# EAGLE design BMS (EAGLE 6.5.0)
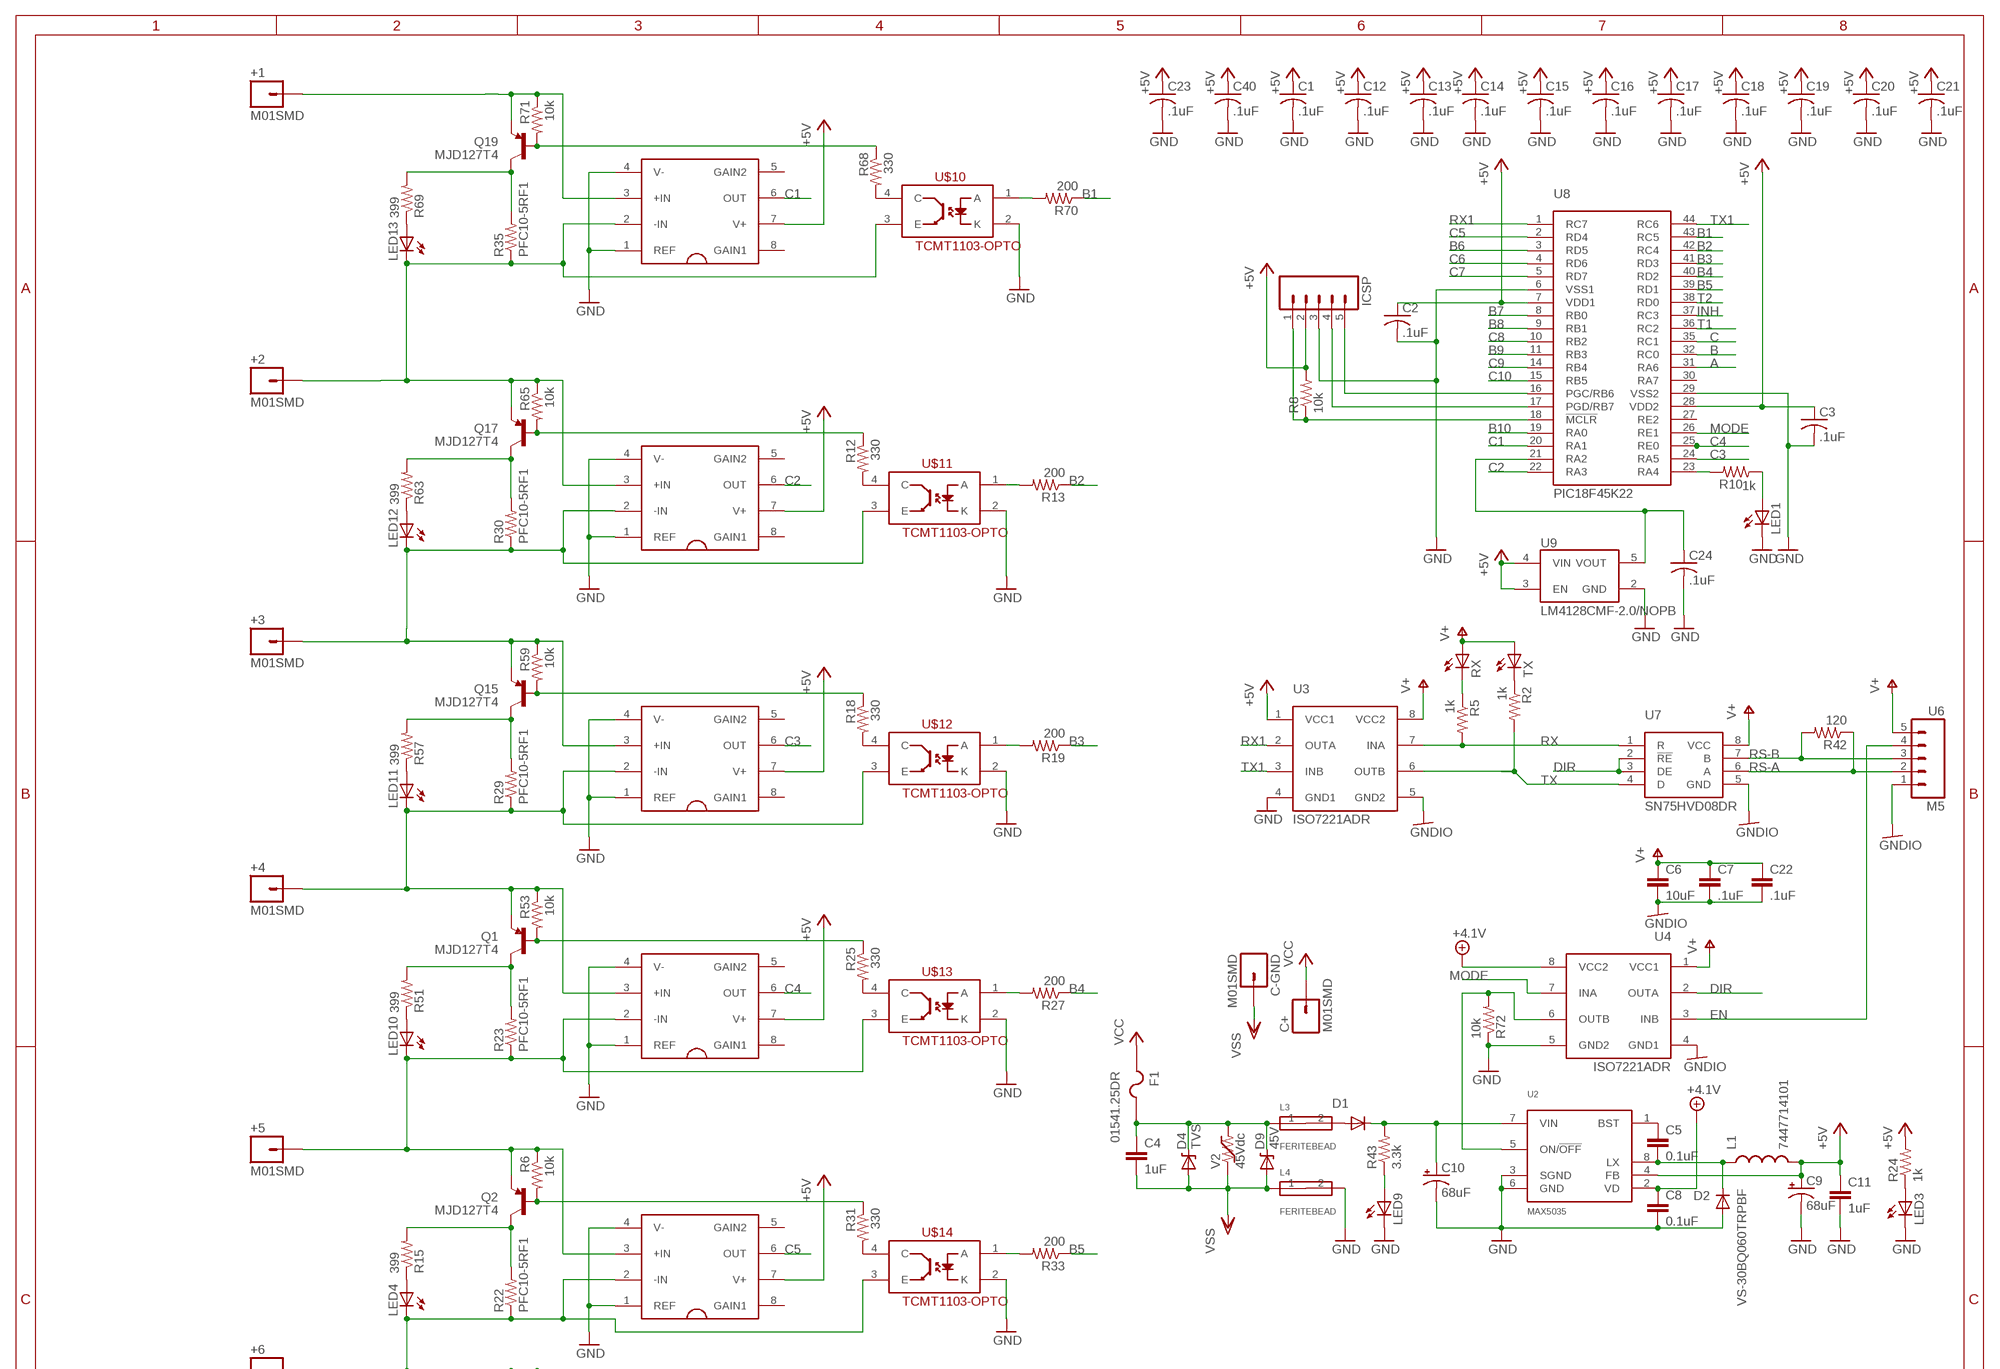
[diagram p0: schematic, sheet 1, part 1 of 2]
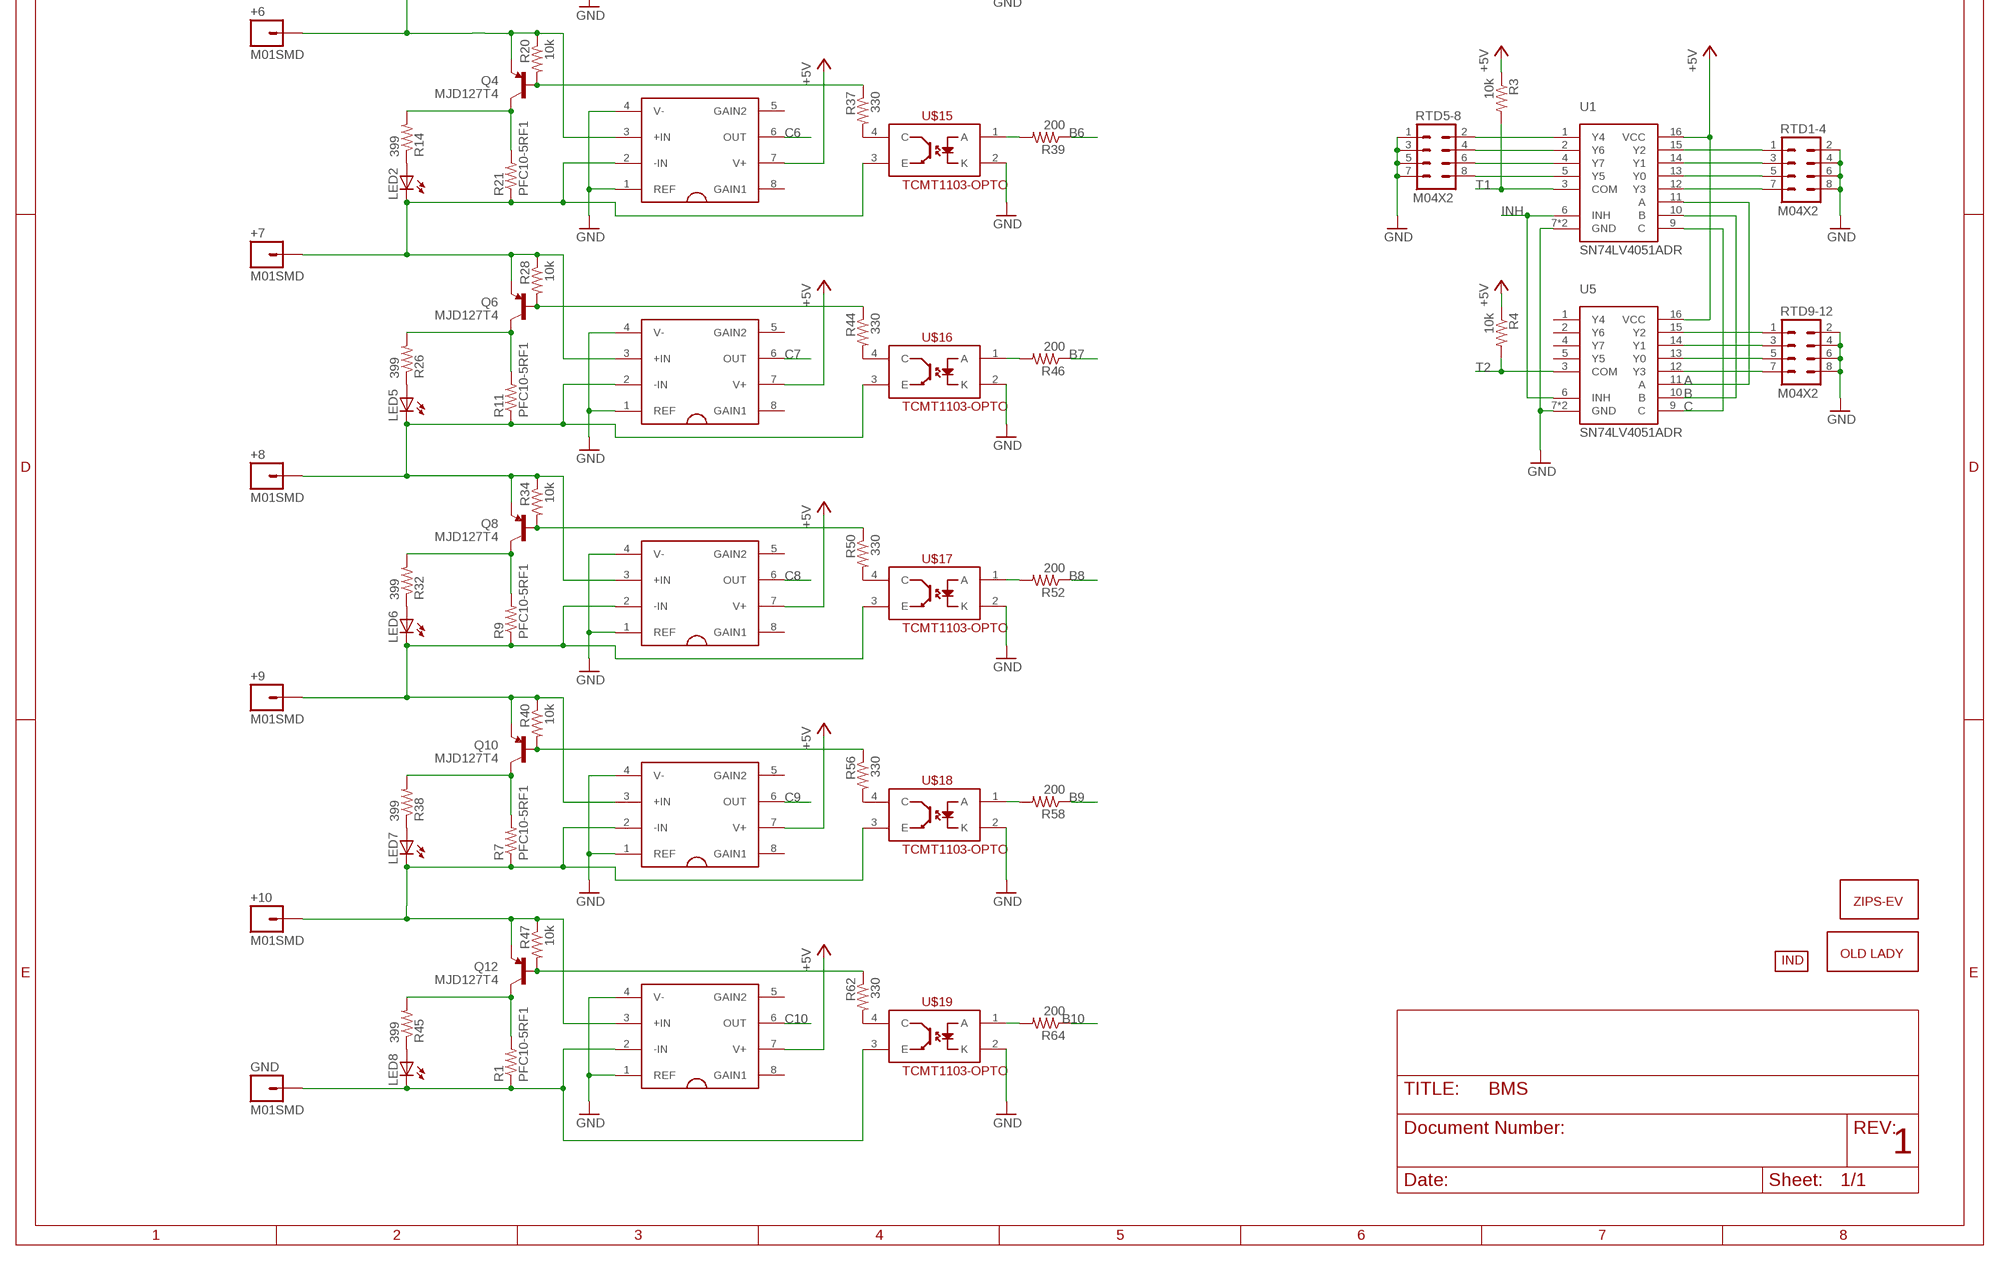
[diagram p1: schematic, sheet 1, part 2 of 2]

## Parts
+1  M01SMD  [LUXEON-PAD]
+2  M01SMD  [LUXEON-PAD]
+3  M01SMD  [LUXEON-PAD]
+4  M01SMD  [LUXEON-PAD]
+5  M01SMD  [LUXEON-PAD]
+6  M01SMD  [LUXEON-PAD]
+7  M01SMD  [LUXEON-PAD]
+8  M01SMD  [LUXEON-PAD]
+9  M01SMD  [LUXEON-PAD]
+10  M01SMD  [LUXEON-PAD]
C1  .1uF  C-USC0805  [C0805]
C2  .1uF  C-USC0805  [C0805]
C3  .1uF  C-USC0805  [C0805]
C4  1uF  CAP1206  [1206]
C5  0.1uF  CAP0805  [0805]
C6  10uF  CAP1206  [1206]
C7  .1uF  CAP0805  [0805]
C8  0.1uF  CAP0805  [0805]
C9  68uF  CAP_POL6032  [EIA6032]
C10  68uF  CAP_POL6032  [EIA6032]
C11  1uF  CAP1210  [1210]
C12  .1uF  C-USC0805  [C0805]
C13  .1uF  C-USC0805  [C0805]
C14  .1uF  C-USC0805  [C0805]
C15  .1uF  C-USC0805  [C0805]
C16  .1uF  C-USC0805  [C0805]
C17  .1uF  C-USC0805  [C0805]
C18  .1uF  C-USC0805  [C0805]
C19  .1uF  C-USC0805  [C0805]
C20  .1uF  C-USC0805  [C0805]
C21  .1uF  C-USC0805  [C0805]
C22  .1uF  CAP0805  [0805]
C23  .1uF  C-USC0805  [C0805]
C24  .1uF  C-USC0805  [C0805]
C40  .1uF  C-USC0805  [C0805]
C+  M01SMD  [LUXEON-PAD]
C-GND  M01SMD  [LUXEON-PAD]
D1  1N4001  DIODE-SOD123  [SOD123]
D2  VS-30BQ060TRPBF  DIODESMC/DO-214AB  [SMC]
D4  TVS  [DO-214AC]
D9  45V  DIODE-ZENERSMB  [SMB-DIODE]
F1  01541.25DR  0154XXDR  [0154XXDR]
GND  M01SMD  [LUXEON-PAD]
ICSP  M05LOCK_LONGPADS  [1X05_LOCK_LONGPADS]
L1  7447714101  INDUCTOR  [INDUCTOR_5X3]
L3  FERITEBEAD  [0603]
L4  FERITEBEAD  [0603]
LED1  LEDCHIP-LED0805  [CHIP-LED0805]
LED2  LEDCHIPLED_0805  [CHIPLED_0805]
LED3  LEDCHIP-LED0805  [CHIP-LED0805]
LED4  LEDCHIPLED_0805  [CHIPLED_0805]
LED5  LEDCHIPLED_0805  [CHIPLED_0805]
LED6  LEDCHIPLED_0805  [CHIPLED_0805]
LED7  LEDCHIPLED_0805  [CHIPLED_0805]
LED8  LEDCHIPLED_0805  [CHIPLED_0805]
LED9  LEDCHIP-LED0805  [CHIP-LED0805]
LED10  LEDCHIPLED_0805  [CHIPLED_0805]
LED11  LEDCHIPLED_0805  [CHIPLED_0805]
LED12  LEDCHIPLED_0805  [CHIPLED_0805]
LED13  LEDCHIPLED_0805  [CHIPLED_0805]
Q1  MJD127T4  [DPAK]
Q2  MJD127T4  [DPAK]
Q4  MJD127T4  [DPAK]
Q6  MJD127T4  [DPAK]
Q8  MJD127T4  [DPAK]
Q10  MJD127T4  [DPAK]
Q12  MJD127T4  [DPAK]
Q15  MJD127T4  [DPAK]
Q17  MJD127T4  [DPAK]
Q19  MJD127T4  [DPAK]
R1  PFC10-5RF1  [PFC10-5RF1]
R2  1k  R-US_R0805  [R0805]
R3  10k  R-US_R0805  [R0805]
R4  10k  R-US_R0805  [R0805]
R5  1k  R-US_R0805  [R0805]
R6  10k  R-US_R0805  [R0805]
R7  PFC10-5RF1  [PFC10-5RF1]
R8  10k  RESISTOR0805-RES  [0805]
R9  PFC10-5RF1  [PFC10-5RF1]
R10  1k  R-US_R0805  [R0805]
R11  PFC10-5RF1  [PFC10-5RF1]
R12  330  R-US_R0805  [R0805]
R13  200  R-US_R0805  [R0805]
R14  399  R-US_R0805  [R0805]
R15  399  R-US_R0805  [R0805]
R18  330  R-US_R0805  [R0805]
R19  200  R-US_R0805  [R0805]
R20  10k  R-US_R0805  [R0805]
R21  PFC10-5RF1  [PFC10-5RF1]
R22  PFC10-5RF1  [PFC10-5RF1]
R23  PFC10-5RF1  [PFC10-5RF1]
R24  1k  R-US_R0805  [R0805]
R25  330  R-US_R0805  [R0805]
R26  399  R-US_R0805  [R0805]
R27  200  R-US_R0805  [R0805]
R28  10k  R-US_R0805  [R0805]
R29  PFC10-5RF1  [PFC10-5RF1]
R30  PFC10-5RF1  [PFC10-5RF1]
R31  330  R-US_R0805  [R0805]
R32  399  R-US_R0805  [R0805]
R33  200  R-US_R0805  [R0805]
R34  10k  R-US_R0805  [R0805]
R35  PFC10-5RF1  [PFC10-5RF1]
R37  330  R-US_R0805  [R0805]
R38  399  R-US_R0805  [R0805]
R39  200  R-US_R0805  [R0805]
R40  10k  R-US_R0805  [R0805]
R42  120  R-US_R0805  [R0805]
R43  3.3k  R-US_R0805  [R0805]
R44  330  R-US_R0805  [R0805]
R45  399  R-US_R0805  [R0805]
R46  200  R-US_R0805  [R0805]
R47  10k  R-US_R0805  [R0805]
R50  330  R-US_R0805  [R0805]
R51  399  R-US_R0805  [R0805]
R52  200  R-US_R0805  [R0805]
R53  10k  R-US_R0805  [R0805]
R56  330  R-US_R0805  [R0805]
R57  399  R-US_R0805  [R0805]
R58  200  R-US_R0805  [R0805]
R59  10k  R-US_R0805  [R0805]
R62  330  R-US_R0805  [R0805]
R63  399  R-US_R0805  [R0805]
R64  200  R-US_R0805  [R0805]
R65  10k  R-US_R0805  [R0805]
R68  330  R-US_R0805  [R0805]
R69  399  R-US_R0805  [R0805]
R70  200  R-US_R0805  [R0805]
R71  10k  R-US_R0805  [R0805]
R72  10k  R-US_R0805  [R0805]
RTD1-4  M04X2  [2X4]
RTD5-8  M04X2  [2X4]
RTD9-12  M04X2  [2X4]
RX  LEDCHIPLED_0805  [CHIPLED_0805]
TX  LEDCHIPLED_0805  [CHIPLED_0805]
U1  SN74LV4051ADR  [SO-16]
U2  MAX5035  [SO-8]
U3  ISO7221ADR  [SOIC-8]
U4  ISO7221ADR  [SOIC-8]
U5  SN74LV4051ADR  [SO-16]
U6  M5  [5-103635-4]
U7  SN75HVD08DR  [SO-8]
U8  PIC18F45K22  [TQFP-44]
U9  LM4128CMF-2.0/NOPB  LM4128-2.5VREF  [SOT23-5]
U$1  LT1990  [LT1990]
U$2  LT1990  [LT1990]
U$3  LT1990  [LT1990]
U$4  LT1990  [LT1990]
U$5  LT1990  [LT1990]
U$6  LT1990  [LT1990]
U$7  LT1990  [LT1990]
U$8  LT1990  [LT1990]
U$9  LT1990  [LT1990]
U$10  TCMT1103-OPTO  [SSOP-4]
U$11  TCMT1103-OPTO  [SSOP-4]
U$12  TCMT1103-OPTO  [SSOP-4]
U$13  TCMT1103-OPTO  [SSOP-4]
U$14  TCMT1103-OPTO  [SSOP-4]
U$15  TCMT1103-OPTO  [SSOP-4]
U$16  TCMT1103-OPTO  [SSOP-4]
U$17  TCMT1103-OPTO  [SSOP-4]
U$18  TCMT1103-OPTO  [SSOP-4]
U$19  TCMT1103-OPTO  [SSOP-4]
U$20  INDPK1  [PICKIT-PIN-1]
U$21  OLD_LADYM  [0L-M]
U$22  LOGO  [L-MS]
U$55  LT1990  [LT1990]
V2  45Vdc  VAR-RES  [0603]

## Nets
+4.1V: C8.1 U2.2(VD) U4.8(VCC2)
+5V: C1.1 C2.1 C3.1 C9.P$1(+) C11.1 C12.1 C13.1 C14.1 C15.1 C16.1 C17.1 C18.1 C19.1 C20.1 C21.1 C23.1 C40.1 ICSP.2 L1.2 R3.1 R4.1 R8.2 R24.2 U1.16(VCC) U2.4(FB) U3.1(VCC1) U5.16(VCC) U8.7(VDD1) U8.28(VDD2) U9.3(EN) U9.4(VIN) U$1.7(V+) U$2.7(V+) U$3.7(V+) U$4.7(V+) U$5.7(V+) U$6.7(V+) U$7.7(V+) U$8.7(V+) U$9.7(V+) U$55.7(V+)
A: U1.11(A) U5.11(A) U8.31(RA6)
B: U1.10(B) U5.10(B) U8.32(RC0)
B1: R70.1 U8.43(RC5)
B2: R13.1 U8.42(RC4)
B3: R19.1 U8.41(RD3)
B4: R27.1 U8.40(RD2)
B5: R33.1 U8.39(RD1)
B6: R39.1 U8.3(RD5)
B7: R46.1 U8.8(RB0)
B8: R52.1 U8.9(RB1)
B9: R58.1 U8.11(RB3)
B10: R64.1 U8.19(RA0)
C: U1.9(C) U5.9(C) U8.35(RC1)
C1: U8.20(RA1) U$9.6(OUT)
C2: U8.22(RA3) U$8.6(OUT)
C3: U8.24(RA5) U$7.6(OUT)
C4: U8.25(RE0) U$6.6(OUT)
C5: U8.2(RD4) U$55.6(OUT)
C6: U8.4(RD6) U$1.6(OUT)
C7: U8.5(RD7) U$2.6(OUT)
C8: U8.10(RB2) U$3.6(OUT)
C9: U8.14(RB4) U$4.6(OUT)
C10: U8.15(RB5) U$5.6(OUT)
DIR: U4.2(OUTA) U7.2(!RE) U7.3(DE)
EN: U4.3(INB) U6.4
GHT: D1.A L3.2
GND: C1.2 C2.2 C3.2 C8.2 C9.P$2(-) C10.P$2(-) C11.2 C12.2 C13.2 C14.2 C15.2 C16.2 C17.2 C18.2 C19.2 C20.2 C21.2 C23.2 C24.2 C40.2 D2.A ICSP.3 L4.2 LED1.C LED3.C LED9.C R72.1 RTD1-4.2 RTD1-4.4 RTD1-4.6 RTD1-4.8 RTD5-8.1 RTD5-8.3 RTD5-8.5 RTD5-8.7 RTD9-12.2 RTD9-12.4 RTD9-12.6 RTD9-12.8 U1.7(GND) U1.8(GND) U2.3(SGND) U2.6(GND) U3.4(GND1) U4.5(GND2) U5.7(GND) U5.8(GND) U8.6(VSS1) U8.29(VSS2) U9.2(GND) U$1.1(REF) U$1.4(V-) U$2.1(REF) U$2.4(V-) U$3.1(REF) U$3.4(V-) U$4.1(REF) U$4.4(V-) U$5.1(REF) U$5.4(V-) U$6.1(REF) U$6.4(V-) U$7.1(REF) U$7.4(V-) U$8.1(REF) U$8.4(V-) U$9.1(REF) U$9.4(V-) U$10.2(K) U$11.2(K) U$12.2(K) U$13.2(K) U$14.2(K) U$15.2(K) U$16.2(K) U$17.2(K) U$18.2(K) U$19.2(K) U$55.1(REF) U$55.4(V-)
GNDIO: C6.2 C7.2 C22.2 U3.5(GND2) U4.4(GND1) U6.1 U7.5(GND)
INH: U1.6(INH) U5.6(INH) U8.37(RC3)
MODE: U4.7(INA) U8.26(RE1)
N$1: LED1.A R10.1
N$2: R10.2 U8.23(RA4)
N$3: C10.P$1(+) D1.C R43.2 U2.7(VIN)
N$4: RTD1-4.1 U1.15(Y2)
N$5: RTD1-4.3 U1.14(Y1)
N$6: C4.1 D4.C D9.C F1.2 L3.1 V2.2
N$7: RTD1-4.5 U1.13(Y0)
N$8: R72.2 U2.5(ON/!OFF) U4.6(OUTB)
N$9: +6.P$1 LED4.C Q4.3(E) R20.1 R22.1 U$1.3(+IN) U$14.3(E) U$55.2(-IN)
N$10: RTD1-4.7 U1.12(Y3)
N$11: RTD9-12.1 U5.15(Y2)
N$12: R2.1 TX.C
N$13: R5.1 RX.C
N$14: RTD9-12.3 U5.14(Y1)
N$15: LED9.A R43.1
N$16: +9.P$1 LED6.C Q10.3(E) R9.1 R40.1 U$3.2(-IN) U$4.3(+IN) U$17.3(E)
N$17: Q2.1(B) R6.2 R31.1
N$18: +10.P$1 LED7.C Q12.3(E) R7.1 R47.1 U$4.2(-IN) U$5.3(+IN) U$18.3(E)
N$19: RTD9-12.5 U5.13(Y0)
N$20: R70.2 U$10.1(A)
N$21: RTD9-12.7 U5.12(Y3)
N$22: R13.2 U$11.1(A)
N$23: Q4.1(B) R20.2 R37.1
N$24: LED4.A R15.1
N$25: LED3.A R24.1
N$26: C5.2 D2.C L1.1 U2.8(LX)
N$27: R68.2 U$10.4(C)
N$28: LED2.A R14.1
N$29: R19.2 U$12.1(A)
N$30: Q4.2(C) R14.2 R21.2
N$31: +8.P$1 LED5.C Q8.3(E) R11.1 R34.1 U$2.2(-IN) U$3.3(+IN) U$16.3(E)
N$32: +7.P$1 LED2.C Q6.3(E) R21.1 R28.1 U$1.2(-IN) U$2.3(+IN) U$15.3(E)
N$33: Q6.1(B) R28.2 R44.1
N$34: R44.2 U$16.4(C)
N$35: LED5.A R26.1
N$36: R27.2 U$13.1(A)
N$37: Q6.2(C) R11.2 R26.2
N$38: C5.1 U2.1(BST)
N$39: C24.1 U8.21(RA2) U9.5(VOUT)
N$40: ICSP.4 U8.17(PGD/RB7)
N$41: Q8.1(B) R34.2 R50.1
N$42: R37.2 U$15.4(C)
N$43: ICSP.5 U8.16(PGC/RB6)
N$44: LED6.A R32.1
N$45: R33.2 U$14.1(A)
N$46: ICSP.1 R8.1 U8.18(!MCLR)
N$47: Q8.2(C) R9.2 R32.2
N$48: RTD5-8.2 U1.1(Y4)
N$49: RTD5-8.4 U1.2(Y6)
N$50: Q10.1(B) R40.2 R56.1
N$51: R62.2 U$19.4(C)
N$52: LED7.A R38.1
N$53: R39.2 U$15.1(A)
N$54: Q10.2(C) R7.2 R38.2
N$55: RTD5-8.6 U1.4(Y7)
N$56: RTD5-8.8 U1.5(Y5)
N$57: Q12.1(B) R47.2 R62.1
N$58: R12.2 U$11.4(C)
N$59: LED8.A R45.1
N$60: R46.2 U$16.1(A)
N$61: Q12.2(C) R1.2 R45.2
N$62: Q1.1(B) R25.1 R53.2
N$63: R18.2 U$12.4(C)
N$64: Q2.2(C) R15.2 R22.2
N$65: R52.2 U$17.1(A)
N$66: LED10.A R51.1
N$67: R25.2 U$13.4(C)
N$68: Q1.2(C) R23.2 R51.2
N$69: +4.P$1 LED11.C Q1.3(E) R29.1 R53.1 U$6.3(+IN) U$7.2(-IN) U$12.3(E)
N$70: +5.P$1 LED10.C Q2.3(E) R6.1 R23.1 U$6.2(-IN) U$13.3(E) U$55.3(+IN)
N$72: Q15.1(B) R18.1 R59.2
N$73: R58.2 U$18.1(A)
N$74: LED11.A R57.1
N$75: R31.2 U$14.4(C)
N$76: Q15.2(C) R29.2 R57.2
N$77: R64.2 U$19.1(A)
N$78: R50.2 U$17.4(C)
N$79: +3.P$1 LED12.C Q15.3(E) R30.1 R59.1 U$7.3(+IN) U$8.2(-IN) U$11.3(E)
N$80: Q17.1(B) R12.1 R65.2
N$81: R56.2 U$18.4(C)
N$82: LED12.A R63.1
N$83: +1.P$1 Q19.3(E) R71.1 U$9.3(+IN)
N$84: Q17.2(C) R30.2 R63.2
N$87: +2.P$1 LED13.C Q17.3(E) R35.1 R65.1 U$8.3(+IN) U$9.2(-IN) U$10.3(E)
N$88: Q19.1(B) R68.1 R71.2
N$89: GND.P$1 LED8.C R1.1 U$5.2(-IN) U$19.3(E)
N$90: LED13.A R69.1
N$92: Q19.2(C) R35.2 R69.2
RS-A: R42.1 U6.2 U7.6(A)
RS-B: R42.2 U6.3 U7.7(B)
RX: R5.2 U3.7(INA) U7.1(R)
RX1: U3.2(OUTA) U8.1(RC7)
T1: R3.2 U1.3(COM) U8.36(RC2)
T2: R4.2 U5.3(COM) U8.38(RD0)
TX: R2.2 U3.6(OUTB) U7.4(D)
TX1: U3.3(INB) U8.44(RC6)
V+: C6.1 C7.1 C22.1 RX.A TX.A U3.8(VCC2) U4.1(VCC1) U6.5 U7.8(VCC)
VCC: C+.P$1 F1.1
VSS: C4.2 C-GND.P$1 D4.A D9.A L4.1 V2.1
Unconnected: U5.1(Y4) U5.2(Y6) U5.4(Y7) U5.5(Y5) U8.27(RE2) U8.30(RA7) U$1.5(GAIN2) U$1.8(GAIN1) U$2.5(GAIN2) U$2.8(GAIN1) U$3.5(GAIN2) U$3.8(GAIN1) U$4.5(GAIN2) U$4.8(GAIN1) U$5.5(GAIN2) U$5.8(GAIN1) U$6.5(GAIN2) U$6.8(GAIN1) U$7.5(GAIN2) U$7.8(GAIN1) U$8.5(GAIN2) U$8.8(GAIN1) U$9.5(GAIN2) U$9.8(GAIN1) U$55.5(GAIN2) U$55.8(GAIN1)

## Notes on the sheet
- 1

## Library data of the parts
+1-+10 C+ C-GND GND = SparkFun-Connectors:M01: Header 1 Standard 1-pin 0.1" header. Use with straight break away headers (SKU : PRT-00116), right angle break away headers (PRT-00553), swiss pins (PRT-00743), machine pins (PRT-00117), and female headers (PRT-00115).
C1-C3 C12-C21 C23 C24 C40 = adafruit:C-US: CAPACITOR, American symbol
C4 C11 = SparkFun-Capacitors:CAP: Capacitor Standard 0603 ceramic capacitor, and 0.1" leaded capacitor.
C5-C8 C22 = SparkFun-Passives:CAP: Capacitor Standard 0603 ceramic capacitor, and 0.1" leaded capacitor.
C9 C10 = SparkFun-Passives:CAP_POL: Capacitor Polarized These are standard SMD and PTH capacitors. Normally 10uF, 47uF, and 100uF in electrolytic and tantalum varieties. Always verify the external diameter of the through hole cap, it varies with capacity, voltage, and manufacturer. The EIA devices should be standard.
D1 = diode:DIODE-: DIODE
D2 = SparkFun-DiscreteSemi:DIODE: Diode These are standard reverse protection diodes and small signal diodes. SMA package can handle up to about 1A. SOD-323 can handle about 200mA. What the SOD-323 package when ordering, there are some mfgs out there that are 5-pin packages.
D4 = NASA_LIB:TVS
D9 = SparkFun:DIODE-ZENER: Zener Diode Production Part - 8199 3.4V Zener Voltage
F1 = FSAE Eletric:0154XXDR
ICSP = SparkFun-Connectors:M05: Header 5 Standard 5-pin 0.1" header. Use with straight break away headers (SKU : PRT-00116), right angle break away headers (PRT-00553), swiss pins (PRT-00743), machine pins (PRT-00117), and female headers (PRT-00115). Molex polarized connector foot print use with SKU : PRT-08230 with associated crimp pins and housings.
L1 = NASA_LIB:INDUCTOR
L3 L4 = EmEndev:FERITEBEAD
LED1-LED13 RX TX = adafruit:LED: LED OSRAM: - CHIPLED LG R971, LG N971, LY N971, LG Q971, LY Q971, LO R971, LY R971 LH N974, LH R974 LS Q976, LO Q976, LY Q976 LO Q996 - Hyper CHIPLED LW Q18S LB Q993, LB Q99A, LB R99A - SideLED LS A670, LO A670, LY A670, LG A670, LP A670 LB A673, LV A673, LT A673, LW A673 LH A674 LY A675 LS A676, LA A676, LO A676, LY A676, LW A676 LS A679, LY A679, LG A679 - Hyper Micro SIDELED® LS Y876, LA Y876, LO Y876, LY Y876 LT Y87S - SmartLED LW L88C, LW L88S LB L89C, LB L89S, LG L890 LS L89K, LO L89K, LY L89K LS L896, LA L896, LO L896, LY L896 - TOPLED LS T670, LO T670, LY T670, LG T670, LP T670 LSG T670, LSP T670, LSY T670, LOP T670, LYG T670 LG T671, LOG T671, LSG T671 LB T673, LV T673, LT T673, LW T673 LH T674 LS T676, LA T676, LO T676, LY T676, LB T676, LH T676, LSB T676, LW T676 LB T67C, LV T67C, LT T67C, LS T67K, LO T67K, LY T67K, LW E67C LS E67B, LA E67B, LO E67B, LY E67B, LB E67C, LV E67C, LT E67C LW T67C LS T679, LY T679, LG T679 LS T770, LO T770, LY T770, LG T770, LP T770 LB T773, LV T773, LT T773, LW T773 LH T774 LS E675, LA E675, LY E675, LS T675 LS T776, LA T776, LO T776, LY T776, LB T776 LHGB T686 LT T68C, LB T68C - Hyper Mini TOPLED® LB M676 - Mini TOPLED Santana® LG M470 LS M47K, LO M47K, LY M47K Source: http://www.osram.convergy.de/
Q1 Q2 Q4 Q6 Q8 Q10 Q12 Q15 Q17 Q19 = FSAE Eletric:MJD127T4
R1 R7 R9 R11 R21-R23 R29 R30 R35 = FSAE Eletric:PFC10-5RF1
R2-R6 R10 R12-R15 R18-R20 R24-R28 R31-R34 R37-R40 R42-R47 R50-R53 R56-R59 R62-R65 R68-R72 = adafruit:R-US_: RESISTOR, American symbol
R8 = SparkFun-Passives:RESISTOR: Resistor Basic schematic elements and footprints for 0603, 1206, and PTH resistors.
RTD1-4 RTD5-8 RTD9-12 = SparkFun-Connectors:M04X2: .1" header, two rows of four.
U1 U5 = FSAE Eletric:SN74LV4051ADR
U2 = FSAE Eletric:MAX5035
U3 U4 = Gasbarre:ISO7221ADR
U6 = FSAE Eletric:M5
U7 = FSAE Eletric:SN75HVD08DR
U8 = FSAE Eletric:PIC18F45K22
U9 = SparkFun-PowerIC:LM4128-2.5VREF: .1% accurate low-current voltage reference
U$1-U$9 U$55 = Sam_Request:LT1990
U$10-U$19 = SparkFun-DiscreteSemi:TCMT1103-OPTO: Optoisolator- NPN output
U$20 = FSAE Eletric:IND
U$21 = Pic:OLD_LADY
U$22 = Pic:LOGO
V2 = EmEndev:VAR-RES

## Board
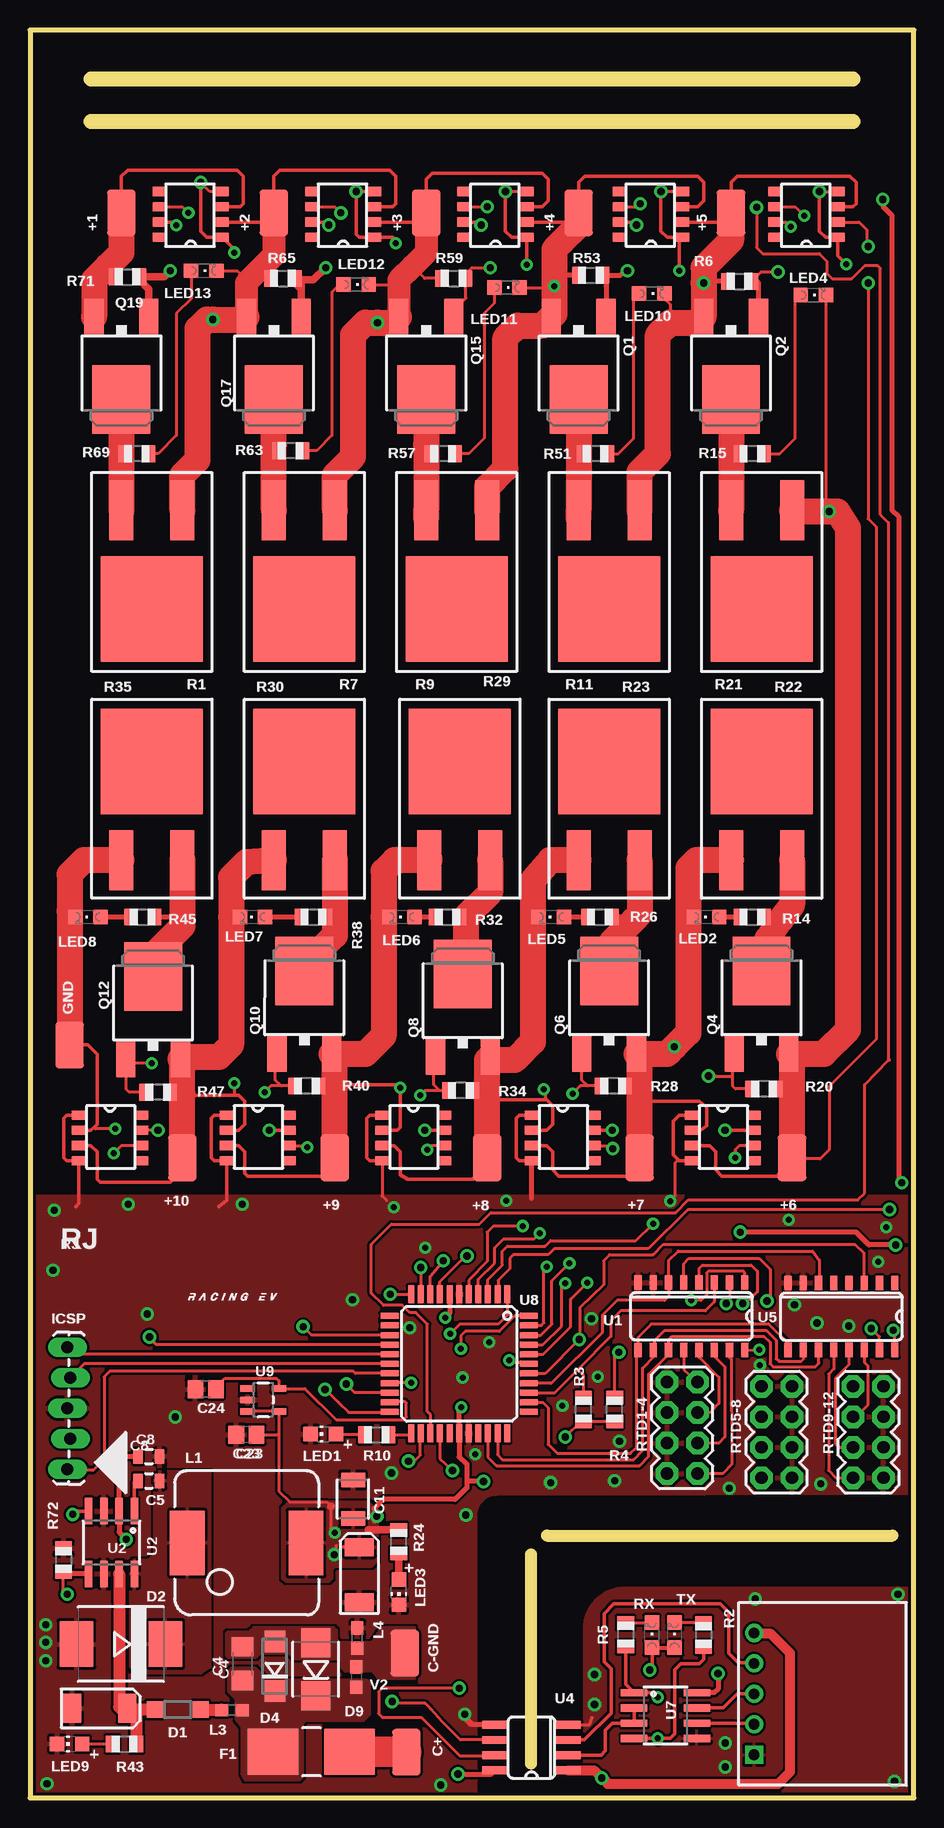
[diagram p2: board, top side]
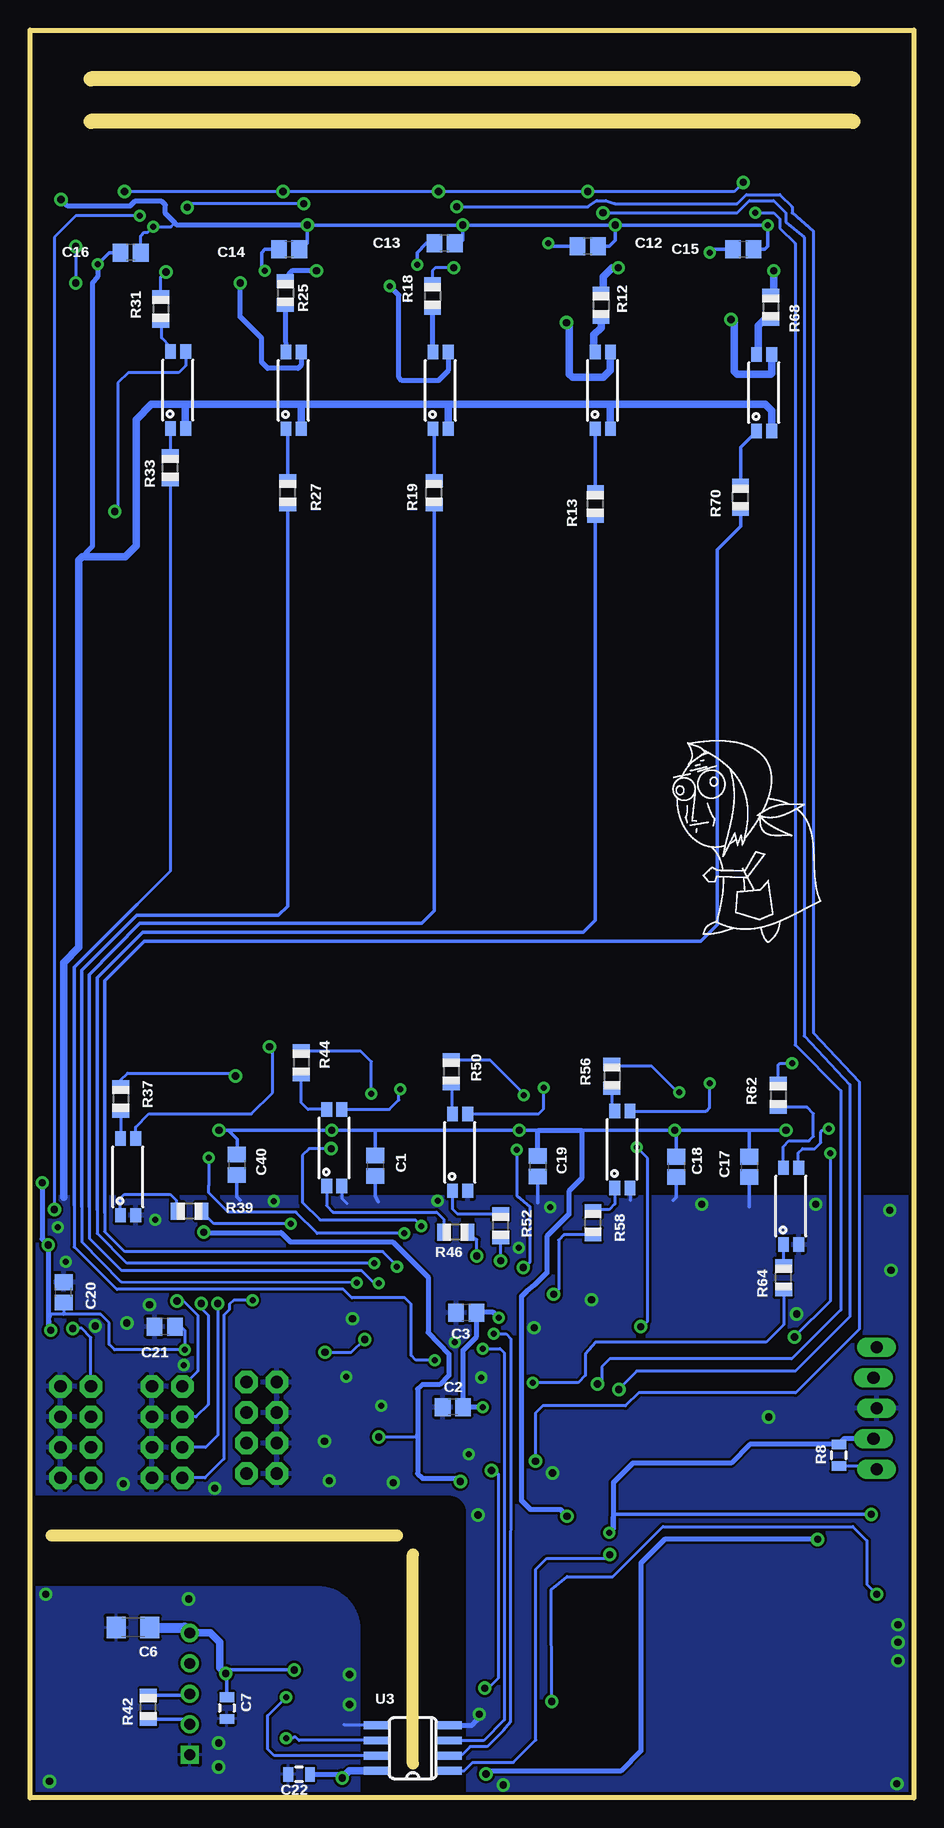
[diagram p3: board, bottom side, seen from below]

Size 73.66 x 147.32 mm. Coordinates in mm from the lower left corner, seen from the top.
Outline: 5.08,143.26 68.58,143.26
Outline: 5.08,139.7 68.58,139.7
Outline: 41.76,2.85 41.76,20.27
Outline: 43.07,21.84 71.88,21.84
Outline: 0,0 73.66,0 73.66,147.32 0,147.32 0,0
Copper layers (1*16): Top 0.035mm / dielectric 1.5mm / Bottom 0.035mm
Design rules "SparkFun": minimum track width 8mil, minimum drill 20mil, track to track 8mil, track to pad 8mil, pad to pad 8mil, via to via 8mil, smd to smd 8mil, copper to edge 10mil, drill to drill 8mil, minimum pad ring 12mil, minimum via ring 10mil, stop-mask expansion 4mil, vias tented up to drill 25mil, thermal gap 10mil

### Footprints (pad centres in the part's own frame; a part is rotated, then mirrored left to right if it is on the bottom)
LUXEON-PAD = smd 3.9 x 2.4: P$1 0,0
C0805 = smd 1.3 x 1.5: 1 -0.85,0; 2 0.85,0
1206 = smd 1.6 x 1.8: 1 -1.4,0; 2 1.4,0
0805 = smd 0.8 x 1.2: 1 -0.9,0; 2 0.9,0
EIA6032 = smd 1.5 x 2.4: P$1 -2.3,0; P$2 2.3,0
1210 = smd 1.2 x 2: 1 -1.6,0; 2 1.6,0
SOD123 = smd 1.4 x 1.4: A 1.9,0; C -1.9,0
SMC = smd 2.8 x 3.8: A 3.7,0; C -3.7,0
DO-214AC = smd 1.8 x 1.7: A 2.05,0; C -2.05,0
SMB-DIODE = smd 2.4 x 2.4: A 2.2,0; C -2.2,0
0154XXDR = smd 4.24 x 3.81: 1 -3.19,0; 2 3.19,0
1X05_LOCK_LONGPADS = drill 1.016 long: 1 0,0; 2 2.54,-0.254; 3 5.08,0; 4 7.62,-0.254; 5 10.16,0
INDUCTOR_5X3 = smd 2.9 x 5.4: 1 -4.95,0; 2 4.95,0
0603 = smd 1.1 x 1: 1 -0.85,0; 2 0.85,0
CHIP-LED0805 = smd 1.2 x 1.2: A 0,-1.05; C 0,1.05
CHIPLED_0805 = smd 1.2 x 1.2: A 0,-1.05; C 0,1.05
DPAK = smd 1.6 x 3: 1 -2.28,-4.04; 3 2.28,-4.04 | smd 4.826 x 5.715: 2 0,2.858
PFC10-5RF1 = smd 2 x 5: 1 -2.54,-8.22; 2 2.54,-8.22 | smd 8.5 x 8.8: TP 0,0
R0805 = smd 1.1 x 1.4: 1 -1,0; 2 1,0
2X4 = drill 1.016 pad 1.88 octagon: 1 -3.81,-1.27; 2 -3.81,1.27; 3 -1.27,-1.27; 4 -1.27,1.27; 5 1.27,-1.27; 6 1.27,1.27; 7 3.81,-1.27; 8 3.81,1.27
SO-16 = smd 0.6 x 1.2: 1 -4.445,-2.8; 2 -3.175,-2.8; 3 -1.905,-2.8; 4 -0.635,-2.8; 5 0.635,-2.8; 6 1.905,-2.8; 7 3.175,-2.8; 8 4.445,-2.8; 9 4.445,2.8; 10 3.175,2.8; 11 1.905,2.8; 12 0.635,2.8; 13 -0.635,2.8; 14 -1.905,2.8; 15 -3.175,2.8; 16 -4.445,2.8
SO-8 = smd 0.61 x 2.21: 1 -1.905,-2.616; 2 -0.635,-2.616; 3 0.635,-2.616; 4 1.905,-2.616; 5 1.905,2.616; 6 0.635,2.616; 7 -0.635,2.616; 8 -1.905,2.616
SOIC-8 = smd 0.66 x 2.032: 1 -1.905,-3.073; 2 -0.635,-3.073; 3 0.635,-3.073; 4 1.905,-3.073; 5 1.905,3.073; 6 0.635,3.073; 7 -0.635,3.073; 8 -1.905,3.073
5-103635-4 = drill 0.9 square: 1 -5.08,0 | drill 0.9: 2 -2.54,0; 3 0,0; 4 2.54,0; 5 5.08,0
TQFP-44 = smd 1.5 x 0.5: 1 -5.8,4; 2 -5.8,3.2; 3 -5.8,2.4; 4 -5.8,1.6; 5 -5.8,0.8; 6 -5.8,0; 7 -5.8,-0.8; 8 -5.8,-1.6; 9 -5.8,-2.4; 10 -5.8,-3.2; 11 -5.8,-4; 23 5.8,-4; 24 5.8,-3.2; 25 5.8,-2.4; 26 5.8,-1.6; 27 5.8,-0.8; 28 5.8,0; 29 5.8,0.8; 30 5.8,1.6; 31 5.8,2.4; 32 5.8,3.2; 33 5.8,4 | smd 0.5 x 1.5: 12 -4,-5.8; 13 -3.2,-5.8; 14 -2.4,-5.8; 15 -1.6,-5.8; 16 -0.8,-5.8; 17 0,-5.8; 18 0.8,-5.8; 19 1.6,-5.8; 20 2.4,-5.8; 21 3.2,-5.8; 22 4,-5.8; 34 4,5.8; 35 3.2,5.8; 36 2.4,5.8; 37 1.6,5.8; 38 0.8,5.8; 39 0,5.8; 40 -0.8,5.8; 41 -1.6,5.8; 42 -2.4,5.8; 43 -3.2,5.8; 44 -4,5.8
SOT23-5 = smd 0.55 x 1.2: 1 -0.95,-1.3; 2 0,-1.3; 3 0.95,-1.3; 4 0.95,1.3; 5 -0.95,1.3
LT1990 = smd 0.762 x 1.143: 1 0,0; 2 1.27,0; 3 2.54,0; 4 3.81,0; 5 3.81,5.207; 6 2.54,5.207; 7 1.27,5.207; 8 0,5.207
SSOP-4 = smd 1.2 x 0.9: 1 -3.2,0.67; 2 -3.2,-0.6; 3 3.2,-0.6; 4 3.2,0.67

### Placement (x,y rotation side)
+1  7.62,132.08 90 top
+2  20.32,132.08 90 top
+3  33.02,132.08 90 top
+4  45.72,132.08 90 top
+5  58.42,132.08 90 top
+6  63.5,53.34 90 top
+7  50.8,53.34 90 top
+8  38.1,53.34 90 top
+9  25.4,53.34 90 top
+10  12.7,53.34 90 top
C1  44.89,52.67 270 bottom
C2  38.41,32.57 180 bottom
C3  37.3,40.43 180 bottom
C4  17.72,11.18 90 top
C5  9.91,26.42 0 top
C6  65.07,14.19 180 bottom
C7  57.26,7.49 270 bottom
C8  9.91,28.45 0 top
C9  27.45,18.6 270 top
C10  5.8,7.46 180 top
C11  26.92,24.89 90 top
C12  27.18,129.29 180 bottom
C13  39.12,129.54 180 bottom
C14  52.07,129.03 180 bottom
C15  14.22,129.03 180 bottom
C16  65.28,128.78 180 bottom
C17  13.72,52.58 270 bottom
C18  19.81,52.58 270 bottom
C19  31.34,52.63 270 bottom
C20  70.87,42.11 90 bottom
C21  62.43,39.27 180 bottom
C22  51.24,1.96 180 bottom
C23  18.04,30.26 180 top
C24  14.64,34.06 180 top
C40  56.43,52.76 270 bottom
C+  31.37,3.81 90 top
C-GND  31.24,12.06 270 top
D1  12.31,7.35 0 top
D2  7.58,12.82 180 top
D4  20.41,10.97 90 top
D9  23.81,10.71 90 top
F1  23.44,3.83 180 top
GND  3.3,62.74 270 top